# EasyEDA Pro project ProPrj_Starcat_FOC双路矢量控制器_2024-11-11.epro, board 双路大功率矢量控制器_3
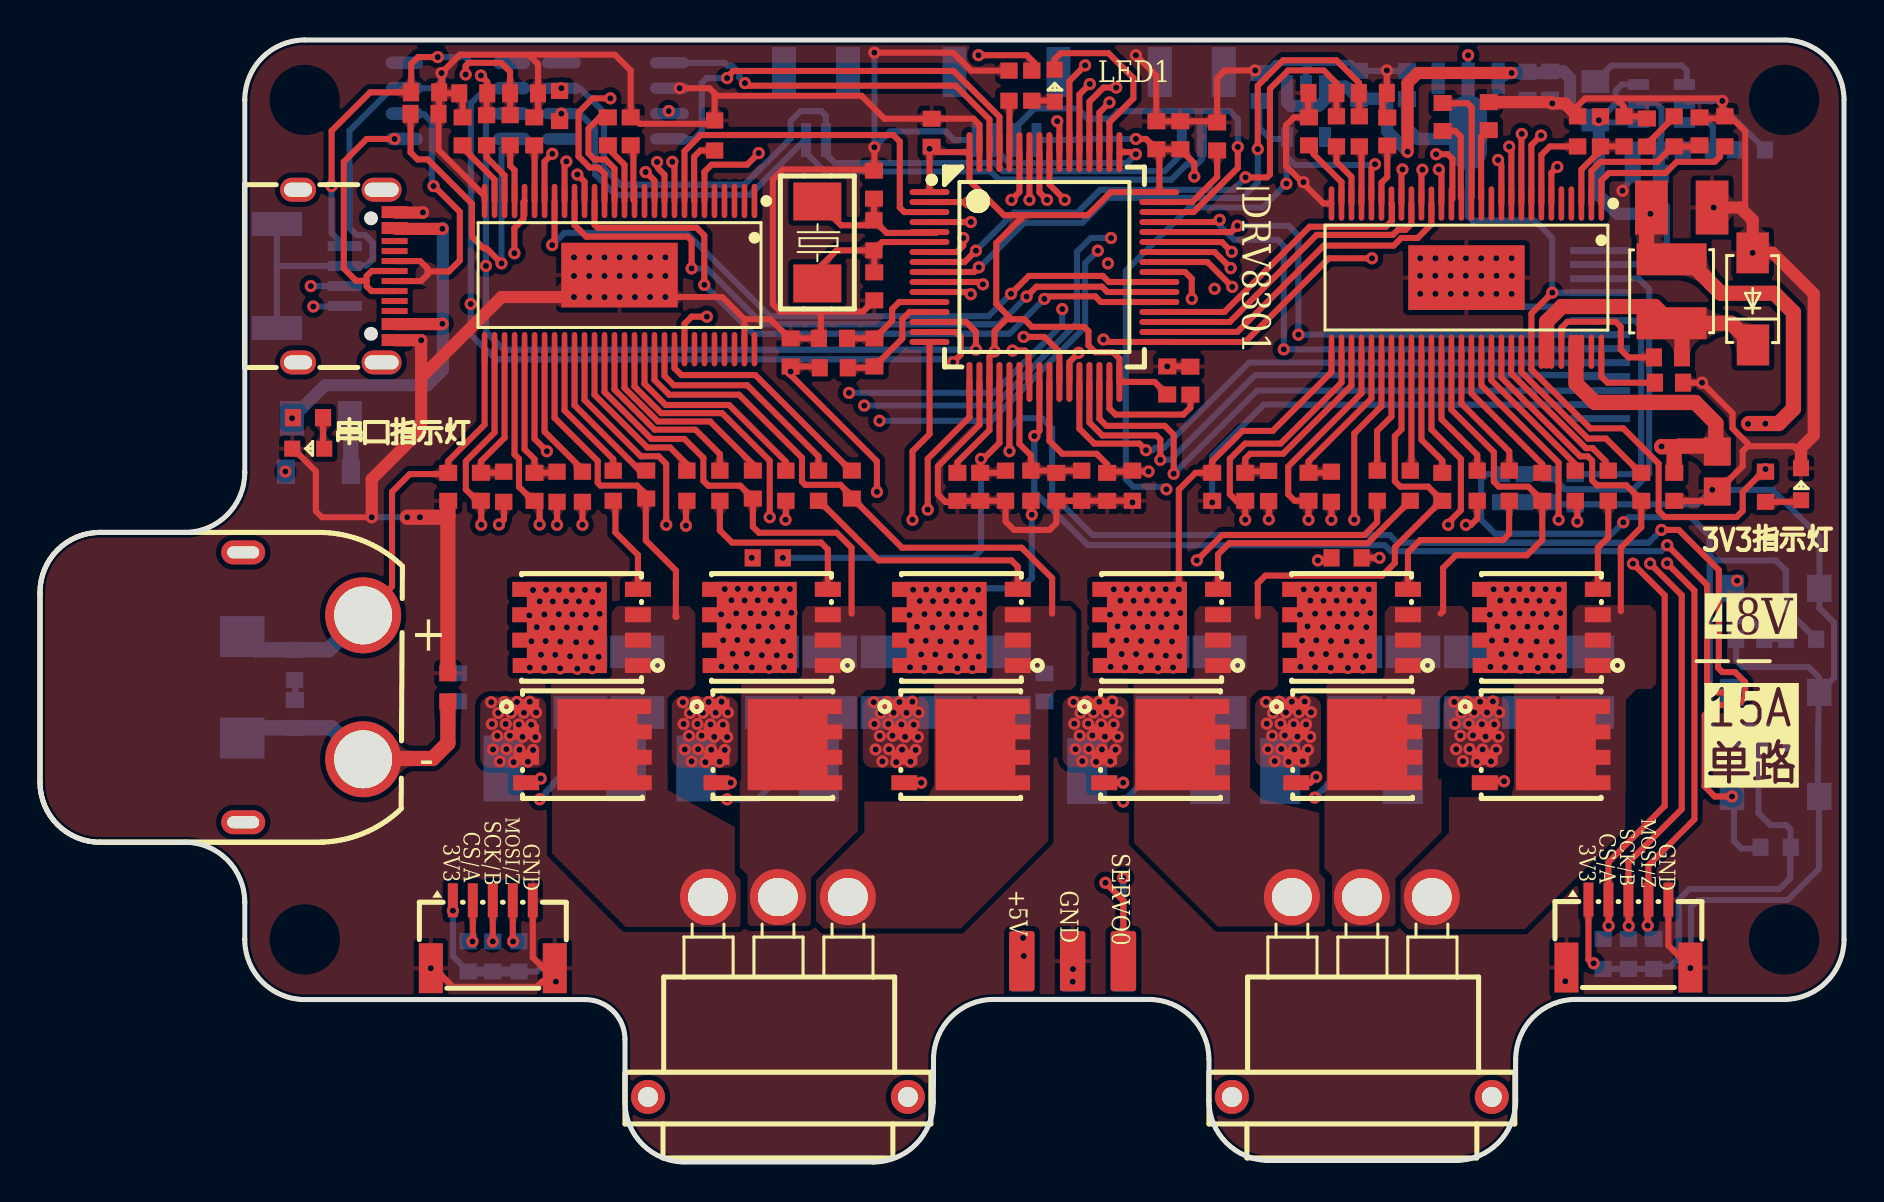
[diagram p9: board, top side]
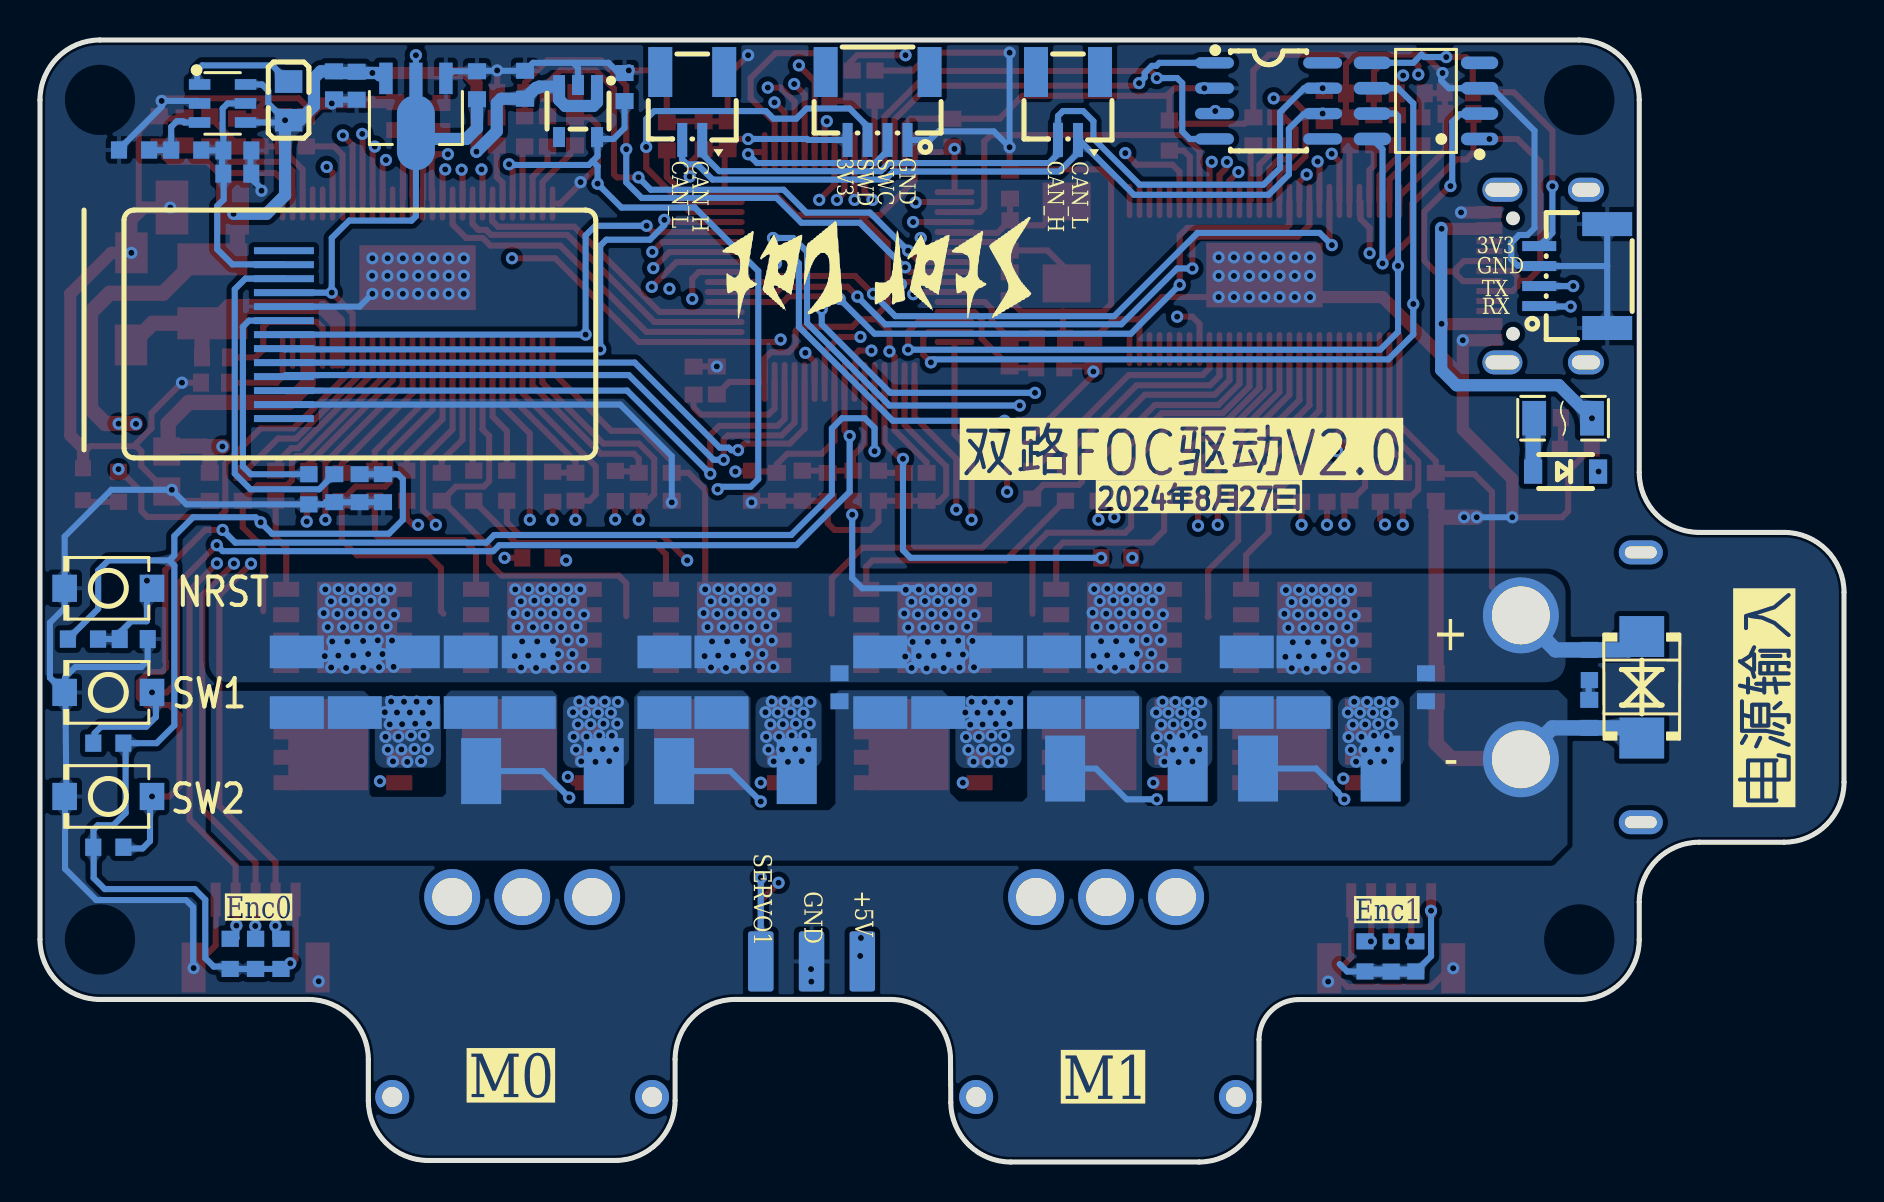
[diagram p10: board, bottom side, seen from below]

Outline 90.24 x 56.13 mm; copper layers: Top Layer, Inner1, Inner2, Bottom Layer. Coordinates in mm from the lower left corner of the outline.
Outline path: 0,28.5 arc(0.88,30.62) 3,31.5 7.24,31.5 arc(9.37,32.38) 10.24,34.5 10.24,53.13 arc(11.12,55.26) 13.24,56.13 87.24,56.13 arc(89.37,55.26) 90.24,53.13 90.24,11.13 arc(89.37,9.01) 87.24,8.13 76.82,8.13 arc(74.7,7.26) 73.82,5.13 73.82,3.08 arc(72.94,0.96) 70.82,0.08 61.47,0.08 arc(59.35,0.96) 58.47,3.08 58.47,5.13 arc(57.6,7.26) 55.47,8.13 47.7,8.13 arc(45.58,7.26) 44.7,5.15 44.68,2.98 arc(43.8,0.87) 41.68,0 32.26,0 arc(30.14,0.88) 29.26,3 29.26,6.13 arc(28.68,7.54) 27.26,8.13 13.24,8.13 arc(11.12,9.01) 10.24,11.13 10.24,13 arc(9.37,15.12) 7.24,16 3,16 arc(0.88,16.88) 0,19 0,28.5
Stack: Top Layer 0.035mm 外层铜厚1oz / Dielectric1 0.2104mm 7628 RC49% 8.6mil / Inner1 0.0152mm 内层铜厚 / Dielectric2 1.065mm 1.1mm H/HOZ Copper / Inner2 0.0152mm 内层铜厚 / Dielectric3 0.2104mm 7628 RC49% 8.6mil / Bottom Layer 0.035mm 外层铜厚1oz

## Design rules (mm)
template: JLCPCB Capability(Two Layers Board)
spacing copperThickness1oz (default): track to track 0.102, other pairs 0.152 to 0.3
spacing copperThickness2oz: track to track 0.203, other pairs 0.152 to 0.3
track width copperThickness1oz (default): min 0.127, default 0.254, max 2.54
track width copperThickness2oz: min 0.203, default 0.254, max 2.54
differential pair differentialPair (default): width min 0.127, default 0.254, max 2.54; gap min 0.152, default 0.152
via viaSize (default): diameter min 0.5, default 0.61, max 10; hole min 0.3, default 0.305, max 6.3

## Placement (name value [footprint] x y rotation side)
C1  1uF  [C0603]  65.98 53.89 270 bottom
C2  100nF  [C0603]  37.55 40.5 90 top
C3  100nF  [C0603]  41.74 40.5 90 top
C4  10uF  [C0603]  74.4 53.85 90 bottom
C5  10uF  [C0603]  68.38 53.87 270 bottom
C6  1uF  [C0603]  61 53.78 270 bottom
C7  10uF  [C0603]  85.56 26.16 0 bottom
C8  100nF  [C0603]  56.39 39.1 90 top
C9  100nF  [C0603]  57.05 51.37 90 top
C10  100nF  [C0603]  45.89 33.78 270 top
C11  100nF  [C0603]  44.6 51.49 90 top
C12  10uF  [C0603]  55.85 51.37 270 top
C13  2.2uF  [C0603]  57.55 39.09 270 top
C14  2.2uF  [C0603]  58.89 51.31 270 top
C15  22pF  [C0603]  41.72 48.9 90 top
C16  22pF  [C0603]  41.73 43.81 270 top
C17  100nF  [C0603]  19.24 52.44 180 top
C18  100nF  [C0603]  19.27 53.51 0 top
C19  1uF  [C0603]  75.54 53.87 90 bottom
C20  10uF  [C0603]  80.37 49.45 0 bottom
C21  10uF  [C0603]  80.37 50.61 0 bottom
C22  100nF  [C0603]  74.26 33.71 270 bottom
C23  10uF  [C0603]  73.08 33.71 90 bottom
C24  10uF  [C0603]  75.52 33.71 270 bottom
C25  100uF  [C1210]  71.6 24 90 bottom
C26  100uF  [C1210]  39.51 24 90 bottom
C27  100uF  [C1210]  36.61 24 90 bottom
C28  100uF  [C1210]  56.16 24 90 bottom
C29  100uF  [C1210]  48.21 24 90 bottom
C30  100uF  [C1210]  27.04 24 90 bottom
C31  100uF  [C1210]  74.5 24 90 bottom
C32  100nF  [C0603]  20.91 23.75 270 bottom
C33  10nF  [C0603]  12.74 22.42 90 bottom
C34  10uF  [C0603]  50.84 33.78 90 top
C35  10uF  [C0603]  53.38 33.78 90 top
C36  10uF  [C0603]  47.03 33.78 90 top
C37  100uF  [C1210]  68.7 24 90 bottom
C38  100uF  [C1210]  42.41 24 90 bottom
C39  100uF  [C1210]  45.31 24 90 bottom
C40  100uF  [C1210]  59.01 24 90 bottom
C41  100uF  [C1210]  65.8 24 90 bottom
C42  100uF  [C1210]  77.4 24 90 bottom
C43  100uF  [C1210]  29.88 24 90 bottom
C44  100nF  [C0603]  50.25 23.75 270 bottom
C45  82pF  [C0603]  83.02 51.56 270 top
C46  270pF  [C0603]  80.39 51.51 270 top
C47  15nF  [C0603]  81.49 38.99 0 top
C48  100nF  [C0603]  81.75 33.78 270 top
C49  10uF  [C0805]  83.9 34.54 90 top
C50  100nF  [C0603]  81.44 40.25 180 top
C51  100uF  [C1210]  82.13 47.75 180 top
C52  100nF  [C0603]  80.1 33.78 270 top
C53  100nF  [C0603]  40.61 33.89 270 top
C54  10uF  [C0603]  72.47 52.32 270 top
C55  100nF  [C0603]  75.15 33.78 270 top
C56  10uF  [C0603]  29.55 51.56 270 top
C57  100nF  [C0603]  35.66 33.89 270 top
C58  47nF  [C0603]  70.16 52.28 90 top
C59  47nF  [C0603]  28.41 51.56 270 top
C60  100nF  [C0603]  70.15 33.78 270 top
C61  100nF  [C0603]  30.33 33.89 270 top
C62  10uF  [C0603]  67.4 51.55 90 top
C63  10uF  [C0603]  24.72 51.56 90 top
C64  2.2nF  [C0603]  63.46 33.78 90 top
C65  2.2nF  [C0603]  24.74 33.78 90 top
C66  2.2nF  [C0603]  66.68 53.48 180 top
C67  2.2nF  [C0603]  24.21 53.47 180 top
C68  10uF  [C0603]  63.48 51.56 270 top
C69  10uF  [C0603]  21.14 51.56 270 top
C70  2.2nF  [C0603]  64.15 53.49 0 top
C71  100nF  [C0603]  58.64 33.78 270 top
C72  2.2nF  [C0603]  60.29 33.78 90 top
C73  2.2nF  [C0603]  21.67 53.47 0 top
C74  100nF  [C0603]  20.42 33.78 270 top
C75  2.2nF  [C0603]  22.06 33.78 90 top
CN1  WAFER-SH1.0-4PWB  [CONN-SMD_4P-P1.00_WAFER-SH1.0-4PWB]  48.34 52.83 0 bottom
CN2  WAFER-SH1.0-4PWB  [CONN-SMD_4P-P1.00_WAFER-SH1.0-4PWB]  13.55 44.32 90 bottom
CN3  XT60PW-M  [CONN-TH_XT60PW-M]  13.17 23.75 0 top
D1  1N5819W  [SOD-123_L2.7-W1.6-LS3.7-R-RD]  13.93 34.54 0 bottom
D2  SMBJ51CA  [SMB_L4.4-W3.6-LS5.4-BI]  10.12 23.75 90 bottom
D3  SS56  [SMA_L4.3-W2.6-LS5.0-FD]  85.68 43.18 270 top
F1  BSMD1206-050-30V  [F1206]  14.05 37.21 0 bottom
L1  CBG160808U000T  [L0603]  20.4 23.75 270 top
L2  22uH  [IND-SMD_L4.0-W4.0]  81.62 43.56 90 top
L3  CBG160808U000T  [L0603]  39.71 39.74 0 top
L4  CBG160808U000T  [L0603]  39.67 41.21 0 top
L5  10uH  [L0805]  77.81 53.09 270 bottom
LED1  XL-1608SURC-06  [LED0603-RD_RED]  88.1 33.91 270 top
LED2  XL-1608SURC-06  [LED0603-RD_RED]  50.76 53.85 270 top
LED3  NCD0603B1  [LED0603-RD]  13.42 35.69 0 top
NRST  TS-1088-AR02016  [SW-SMD_L3.9-W3.0-P4.45]  86.83 28.7 0 bottom
Q1  AMS1117-3.3V  [SOT-89-3_L4.5-W2.5-P1.50-LS4.2-BR]  71.44 52.86 90 bottom
Q2  BSC070N10NS3G  [PG-TDSON-8_L5.0-W6.0-P1.27-BL-EP]  75.11 26.74 90 top
Q3  BSC070N10NS3G  [PG-TDSON-8_L5.0-W6.0-P1.27-BL-EP]  65.61 26.74 90 top
Q4  BSC070N10NS3G  [PG-TDSON-8_L5.0-W6.0-P1.27-BL-EP]  56.11 26.74 90 top
Q5  BSC070N10NS3G  [PG-TDSON-8_L5.0-W6.0-P1.27-BL-EP]  46.09 26.74 90 top
Q6  BSC070N10NS3G  [PG-TDSON-8_L5.0-W6.0-P1.27-BL-EP]  36.59 26.74 90 top
Q7  BSC070N10NS3G  [PG-TDSON-8_L5.0-W6.0-P1.27-BL-EP]  27.09 26.74 90 top
Q8  BSC070N10NS3G  [PG-TDSON-8_L5.0-W6.0-P1.27-BL-EP]  65.66 20.88 270 top
Q9  BSC070N10NS3G  [PG-TDSON-8_L5.0-W6.0-P1.27-BL-EP]  56.05 20.88 270 top
Q10  BSC070N10NS3G  [PG-TDSON-8_L5.0-W6.0-P1.27-BL-EP]  46.06 20.88 270 top
Q11  BSC070N10NS3G  [PG-TDSON-8_L5.0-W6.0-P1.27-BL-EP]  36.66 20.88 270 top
Q12  BSC070N10NS3G  [PG-TDSON-8_L5.0-W6.0-P1.27-BL-EP]  27.14 20.88 270 top
Q13  BSC070N10NS3G  [PG-TDSON-8_L5.0-W6.0-P1.27-BL-EP]  75.09 20.88 270 top
R1  10kΩ  [R0603#2]  86.32 33.78 90 top
R2  3.3Ω  [R0603#2]  12.74 24.87 90 bottom
R3  10kΩ  [R0603#2]  88.1 26.16 180 bottom
R4  10kΩ  [R0603#2]  48.47 53.85 90 top
R5  1kΩ  [R0603#2]  49.61 53.85 90 top
R6  1MΩ  [R0603#2]  41.72 46.36 90 top
R7  10kΩ  [R0603]  13.42 37.21 180 top
R8  10kΩ  [R0603#2]  86.83 20.95 0 bottom
R9  120Ω  [R0603#2]  25.99 52.83 90 top
R10  10kΩ  [R0603#2]  86.83 15.75 180 bottom
R11  750kΩ  [R0603#2]  82.93 50.62 180 bottom
R12  3.3kΩ  [R0603#2]  21.42 10.29 270 bottom
R13  3.3kΩ  [R0603#2]  22.65 10.28 270 bottom
R14  3.3kΩ  [R0603#2]  23.96 10.29 270 bottom
R15  75kΩ  [R0603#2]  85.54 50.63 180 bottom
R16  3.3kΩ  [R0603#2]  78.19 10.41 270 bottom
R17  3.3kΩ  [R0603#2]  79.46 10.41 270 bottom
R18  3.3kΩ  [R0603#2]  80.73 10.41 270 bottom
R19  750kΩ  [R0603#2]  76.79 33.65 90 bottom
R20  39kΩ  [R0603#2]  49.57 33.83 270 top
R21  NCP18XH103F03RB  [R0603#2]  65.36 30.23 0 top
R22  NCP18XH103F03RB  [R0603#2]  36.41 30.23 180 top
R23  2.2kΩ  [R0603#2]  52.11 33.83 90 top
R24  3.3kΩ  [R0603#2]  54.65 33.83 90 top
R25  3.3kΩ  [R0603#2]  48.3 33.83 90 top
R26  47kΩ  [R0603#2]  81.75 51.56 270 top
R27  220kΩ  [R0603#2]  84.29 51.56 90 top
R28  18kΩ  [R0603#2]  78.06 51.56 270 top
R29  3.3kΩ  [R0603#2]  79.24 51.56 270 top
R30  18kΩ  [R0603#2]  33.75 51.36 90 top
R31  18kΩ  [R0603#2]  76.92 51.56 90 top
R32  22Ω  [R0603#2]  66 51.56 270 top
R33  120Ω  [R0603#2]  64.6 33.78 270 top
R34  22Ω  [R0603#2]  23.52 51.62 270 top
R35  120Ω  [R0603#2]  25.87 33.78 270 top
R36  22Ω  [R0603#2]  64.85 51.56 270 top
R37  120Ω  [R0603#2]  61.46 33.82 270 top
R38  22Ω  [R0603#2]  22.34 51.62 270 top
R39  120Ω  [R0603#2]  23.2 33.78 270 top
R40  2.2Ω  [R0603#2]  78.45 33.83 270 top
R41  2.2Ω  [R0603#2]  73.5 33.83 270 top
R42  2.2Ω  [R0603#2]  68.55 33.83 270 top
R43  2.2Ω  [R0603#2]  38.95 33.83 270 top
R44  2.2Ω  [R0603#2]  34.01 33.83 270 top
R45  2.2Ω  [R0603#2]  28.68 33.83 270 top
R46  2.2Ω  [R0603#2]  71.9 33.83 270 top
R47  2.2Ω  [R0603#2]  66.89 33.83 270 top
R48  2.2Ω  [R0603#2]  37.31 33.83 270 top
R49  2.2Ω  [R0603#2]  32.36 33.83 270 top
R50  2.2Ω  [R0603#2]  27.14 33.78 270 top
R51  2.2Ω  [R0603#2]  76.8 33.83 270 top
R52  10mΩ  [RES-SMD_L6.4-W3.2-R2512]  65.11 19.56 180 bottom
R53  10mΩ  [RES-SMD_L6.4-W3.2-R2512]  55.46 19.56 180 bottom
R54  10mΩ  [RES-SMD_L6.4-W3.2-R2512]  35.9 19.68 180 bottom
R55  10mΩ  [RES-SMD_L6.4-W3.2-R2512]  26.25 19.68 180 bottom
SW1  TS-1088-AR02016  [SW-SMD_L3.9-W3.0-P4.45]  86.83 23.49 0 bottom
SW2  TS-1088-AR02016  [SW-SMD_L3.9-W3.0-P4.45]  86.83 18.29 0 bottom
U1  LP5907MFX-3.3/NOPB  [SOT-23-5_L3.0-W1.7-P0.95-LS2.8-BR]  63.33 52.58 90 bottom
U2  -  [3p排针 贴片]  51.66 10.05 0 top
U3  -  [3p排针 贴片]  51.65 10.03 180 bottom
U4  CH340N  [SOP-8_L4.9-W3.9-P1.27-LS6.0-BL]  20.91 53.09 90 bottom
U5  SN65HVD232DR  [SOIC-8_L5.0-W4.0-P1.27-LS6.0-BL]  28.79 53.09 270 bottom
U6  TLV61046ADBVR  [SOT-23-6_L2.9-W1.6-P0.95-LS2.8-BL]  81.11 52.96 270 bottom
U7  WAFER-SH1.0-2PWB  [CONN-SMD_2P-P1.00_XUNPU_WAFER-SH1.0-2PWB]  38.82 52.83 0 bottom
U8  WAFER-SH1.0-2PWB  [CONN-SMD_2P-P1.00_XUNPU_WAFER-SH1.0-2PWB]  57.62 52.83 0 bottom
U9  ZX-SH1.0-5PWT  [CONN-SMD_5P-P1.00_MEGASTAR_ZX-SH1.0-5PWT]  22.65 11.4 0 top
U10  OLED-128x80-0.78寸  [oled-128x80-0.78寸]  62.44 47.62 270 bottom
U11  ZX-SH1.0-5PWT  [CONN-SMD_5P-P1.00_MEGASTAR_ZX-SH1.0-5PWT]  79.46 11.43 0 top
U12  STM32F405RGT6  [LQFP-64_L10.0-W10.0-P0.50-LS12.0-BL]  50.25 44.78 270 top
U13  MR30PW-M30.G.Y  [CONN-TH_MR30PW-M30-G-Y]  36.91 8.25 0 top
U14  MR30PW-M30.G.Y  [CONN-TH_MR30PW-M30-G-Y]  66.12 8.25 0 top
U15  DRV8301DCAR  [HTSSOP-56_L14.0-W6.0-P0.50-LS8.0-BL]  71.36 44.24 180 top
U16  DRV8301DCAR  [HTSSOP-56_L14.0-W6.0-P0.50-LS8.0-BL]  28.99 44.37 180 top
USB1  KH-TYPE-C-16P  [USB-C-SMD_KH-TYPE-C-16P]  15.32 44.32 270 top
X1  8MHz  [CRYSTAL-SMD_L5.0-W3.2]  38.89 46 90 top

## Footprints (pads in the part's own frame, mm; a bottom-side part is the same pattern mirrored in y, then rotated)
3p排针 贴片
  rrect 1.27x3 smd: 1(-2.54,0) 2(0,0) 3(2.54,0)
C0603
  rect 0.8x0.9 smd: 1(-0.7,0) 2(0.7,0)
C0805
  rect 1.41x1.35 smd: 1(-1,0) 2(1,0)
C1210
  rect 1.635x2.7 smd: 1(-1.518,0) 2(1.518,0)
CONN-SMD_2P-P1.00_XUNPU_WAFER-SH1.0-2PWB
  rect 0.5x1.7 smd: 1(-0.5,1.7) 2(0.5,1.7)
  rect 1.2x2.5 smd: 3(1.6,-1.7) 4(-1.6,-1.7)
CONN-SMD_4P-P1.00_WAFER-SH1.0-4PWB
  rect 0.5x1.7 smd: 1(-1.5,1.7) 2(-0.5,1.7) 3(0.5,1.7) 4(1.5,1.7)
  rect 1.2x2.5 smd: 5(-2.6,-1.7) 6(2.6,-1.7)
CONN-SMD_5P-P1.00_MEGASTAR_ZX-SH1.0-5PWT
  rect 0.5x1.7 smd: 1(-2,1.7) 2(-1,1.7) 3(0,1.7) 4(1,1.7) 5(2,1.7)
  rect 1.2x2.5 smd: 6(3.1,-1.7) 7(-3.1,-1.7)
CONN-TH_MR30PW-M30-G-Y
  round 2.8 hole 1.995x1.9: 1(-3.5,5) 2(0,5) 3(3.5,5)
  round 1.7 hole 1: 4(6.5,-5) 5(-6.5,-5)
CONN-TH_XT60PW-M
  round 3.8 hole 2.9: 1(3,-3.6) 2(3,3.6)
  oval 2.2x1.2 hole 1.6x0.6: 3(-3,6.75) 4(-3,-6.75)
CRYSTAL-SMD_L5.0-W3.2
  rect 1.9x2.4 smd: 1(-2.05,0) 2(2.05,0)
F1206
  rect 1.19x1.728 smd: 1(-1.445,0) 2(1.445,0)
HTSSOP-56_L14.0-W6.0-P0.50-LS8.0-BL
  oval 0.28x1.715 smd: 1(-6.75,-3.708) 2(-6.25,-3.708) 3(-5.75,-3.708) 4(-5.25,-3.708) 5(-4.75,-3.708) 6(-4.25,-3.708) 7(-3.75,-3.708) 8(-3.25,-3.708) 9(-2.75,-3.708) 10(-2.25,-3.708) 11(-1.75,-3.708) 12(-1.25,-3.708) 13(-0.75,-3.708) 14(-0.25,-3.708) 15(0.25,-3.708) 16(0.75,-3.708) 17(1.25,-3.708) 18(1.75,-3.708) 19(2.25,-3.708) 20(2.75,-3.708) 21(3.25,-3.708) 22(3.75,-3.708) 23(4.25,-3.708) 24(4.75,-3.708) 25(5.25,-3.708) 26(5.75,-3.708) 27(6.25,-3.708) 28(6.75,-3.708) 29(6.75,3.708) 30(6.25,3.708) 31(5.75,3.708) 32(5.25,3.708) 33(4.75,3.708) 34(4.25,3.708) 35(3.75,3.708) 36(3.25,3.708) 37(2.75,3.708) 38(2.25,3.708) 39(1.75,3.708) 40(1.25,3.708) 41(0.75,3.708) 42(0.25,3.708) 43(-0.25,3.708) 44(-0.75,3.708) 45(-1.25,3.708) 46(-1.75,3.708) 47(-2.25,3.708) 48(-2.75,3.708) 49(-3.25,3.708) 50(-3.75,3.708) 51(-4.25,3.708) 52(-4.75,3.708) 53(-5.25,3.708) 54(-5.75,3.708) 55(-6.25,3.708) 56(-6.75,3.708)
  rect 5.825x3.235 smd: 57(0,0)
IND-SMD_L4.0-W4.0
  rect 1.6x3.5 smd: 1(-1.6,0) 2(1.6,0)
L0603
  rect 0.8x0.864 smd: 1(-0.7,0) 2(0.7,0)
L0805
  rect 1.133x1.377 smd: 1(-0.966,0) 2(0.966,0)
LED0603-RD
  rect 0.8x0.8 smd: 1(-0.799,0) 2(0.799,0)
LED0603-RD_RED
  rect 0.8x0.8 smd: 1(-0.799,-0.004) 2(0.799,0.004)
LQFP-64_L10.0-W10.0-P0.50-LS12.0-BL
  oval 0.3x2 smd: 1(-3.75,-5.75) 2(-3.25,-5.75) 3(-2.75,-5.75) 4(-2.25,-5.75) 5(-1.75,-5.75) 6(-1.25,-5.75) 7(-0.75,-5.75) 8(-0.25,-5.75) 9(0.25,-5.75) 10(0.75,-5.75) 11(1.25,-5.75) 12(1.75,-5.75) 13(2.25,-5.75) 14(2.75,-5.75) 15(3.25,-5.75) 16(3.75,-5.75) 33(3.75,5.75) 34(3.25,5.75) 35(2.75,5.75) 36(2.25,5.75) 37(1.75,5.75) 38(1.25,5.75) 39(0.75,5.75) 40(0.25,5.75) 41(-0.25,5.75) 42(-0.75,5.75) 43(-1.25,5.75) 44(-1.75,5.75) 45(-2.25,5.75) 46(-2.75,5.75) 47(-3.25,5.75) 48(-3.75,5.75)
  oval 2x0.3 smd: 17(5.75,-3.75) 18(5.75,-3.25) 19(5.75,-2.75) 20(5.75,-2.25) 21(5.75,-1.75) 22(5.75,-1.25) 23(5.75,-0.75) 24(5.75,-0.25) 25(5.75,0.25) 26(5.75,0.75) 27(5.75,1.25) 28(5.75,1.75) 29(5.75,2.25) 30(5.75,2.75) 31(5.75,3.25) 32(5.75,3.75) 49(-5.75,3.75) 50(-5.75,3.25) 51(-5.75,2.75) 52(-5.75,2.25) 53(-5.75,1.75) 54(-5.75,1.25) 55(-5.75,0.75) 56(-5.75,0.25) 57(-5.75,-0.25) 58(-5.75,-0.75) 59(-5.75,-1.25) 60(-5.75,-1.75) 61(-5.75,-2.25) 62(-5.75,-2.75) 63(-5.75,-3.25) 64(-5.75,-3.75)
oled-128x80-0.78寸
  rect 0.35x3 smd: 1(2.032,-15.6) 2(2.732,-15.6) 3(3.432,-15.6) 4(4.132,-15.6) 5(4.832,-15.6) 6(5.532,-15.6) 7(6.232,-15.6) 8(6.932,-15.6) 9(7.632,-15.6) 10(8.332,-15.6) 11(9.032,-15.6) 12(9.732,-15.6) 13(10.432,-15.6)
PG-TDSON-8_L5.0-W6.0-P1.27-BL-EP
  rect 0.75x1.3 smd: 1(-1.905,-2.82) 2(-0.635,-2.82) 3(0.635,-2.82) 4(1.905,-2.82) 5(1.905,2.82) 6(0.635,2.82) 7(-0.635,2.82) 8(-1.905,2.794)
  rect 4.56x4 smd: 8(0,0.737)
R0603
  rect 0.806x0.864 smd: 1(-0.741,-0.027) 2(0.766,-0.027)
R0603#2
  rect 0.806x0.864 smd: 1(-0.753,0) 2(0.753,0)
RES-SMD_L6.4-W3.2-R2512
  rect 2x3.3 smd: 1(-3.067,0) 2(3.067,0)
SMA_L4.3-W2.6-LS5.0-FD
  rect 2.046x1.62 smd: 1(-2.304,-0.009) 2(2.304,0.009)
SMB_L4.4-W3.6-LS5.4-BI
  rect 2.047x2.241 smd: 1(-2.54,0) 2(2.54,0)
SOD-123_L2.7-W1.6-LS3.7-R-RD
  rect 0.909x1.219 smd: 1(1.625,0) 2(-1.625,0)
SOIC-8_L5.0-W4.0-P1.27-LS6.0-BL
  oval 0.569x1.95 smd: 1(-1.905,-2.705) 2(-0.635,-2.705) 3(0.635,-2.705) 4(1.905,-2.705) 5(1.905,2.705) 6(0.635,2.705) 7(-0.635,2.705) 8(-1.905,2.705)
SOP-8_L4.9-W3.9-P1.27-LS6.0-BL
  oval 0.63x1.865 smd: 1(-1.905,-2.683) 2(-0.635,-2.683) 3(0.635,-2.683) 4(1.905,-2.683) 5(1.905,2.683) 6(0.635,2.683) 7(-0.635,2.683) 8(-1.905,2.683)
SOT-23-5_L3.0-W1.7-P0.95-LS2.8-BR
  rect 1x0.6 smd: 1(1.3,-0.95) 2(1.3,0) 3(1.3,0.95) 4(-1.3,0.95) 5(-1.3,-0.95)
SOT-23-6_L2.9-W1.6-P0.95-LS2.8-BL
  rect 0.532x1.072 smd: 1(-0.95,-1.149) 2(0,-1.149) 3(0.95,-1.149) 4(0.95,1.149) 5(0,1.149) 6(-0.95,1.149)
SOT-89-3_L4.5-W2.5-P1.50-LS4.2-BR
  rect 1.575x0.672 smd: 1(1.356,-1.5) 3(1.356,1.5)
  custom 5.377x1.9 smd: 2(-1.356,0)
SW-SMD_L3.9-W3.0-P4.45
  rect 1.23x1.36 smd: 1(-2.185,0) 2(2.185,0)
USB-C-SMD_KH-TYPE-C-16P
  oval 1.2x2 hole 0.7x1.7: 1(-4.32,1.765) 2(4.32,1.765)
  oval 1.2x1.8 hole 0.7x1.4: 3(-4.32,-2.415) 4(4.32,-2.415)
  rect 0.3x1.3 smd: A1(-3.35,2.415) A4(-2.55,2.415) A5(-1.25,2.415) A6(-0.25,2.415) A7(0.25,2.415) A8(1.25,2.415) A9(2.55,2.415) A12(3.35,2.415) B1(3.05,2.415) B4(2.25,2.415) B5(1.75,2.415) B6(0.75,2.415) B7(-0.75,2.415) B8(-1.75,2.415) B9(-2.25,2.415) B12(-3.05,2.415)

## Nets
As in the schematic.

Pads without a net: CN1 5 6; CN3 3 4; U1 4; U4 4; U5 5 8; U7 3 4; U8 3 4; U10 1 13; U13 4 5; U14 4 5; U15 4 5 12 55; U16 1 2 3 4 5 12 50 51 52 53 54 56; USB1 1 2 3 4 A5 A8 B5 B8

## Via types
v1: diameter 0.61, hole 0.305, Top Layer to Bottom Layer, 604 vias
